# EAGLE board Resistor_Resistor (EAGLE 8.3.0), part 1 of 32
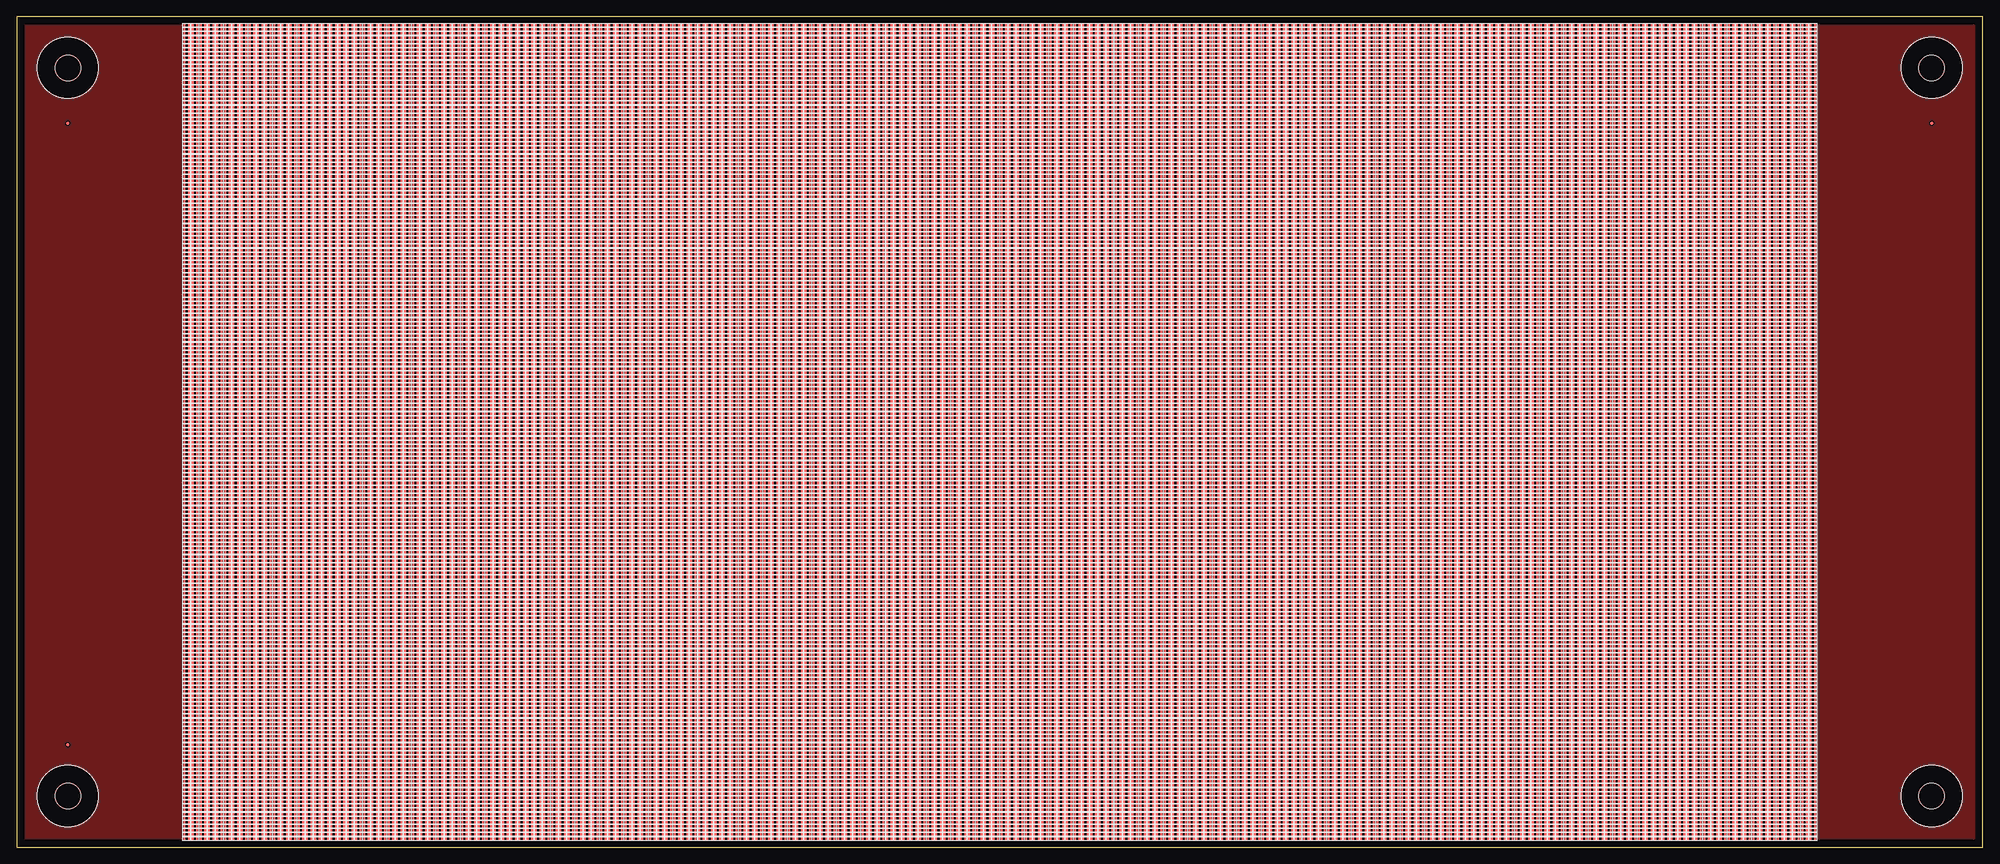
[diagram p9: board, top side]
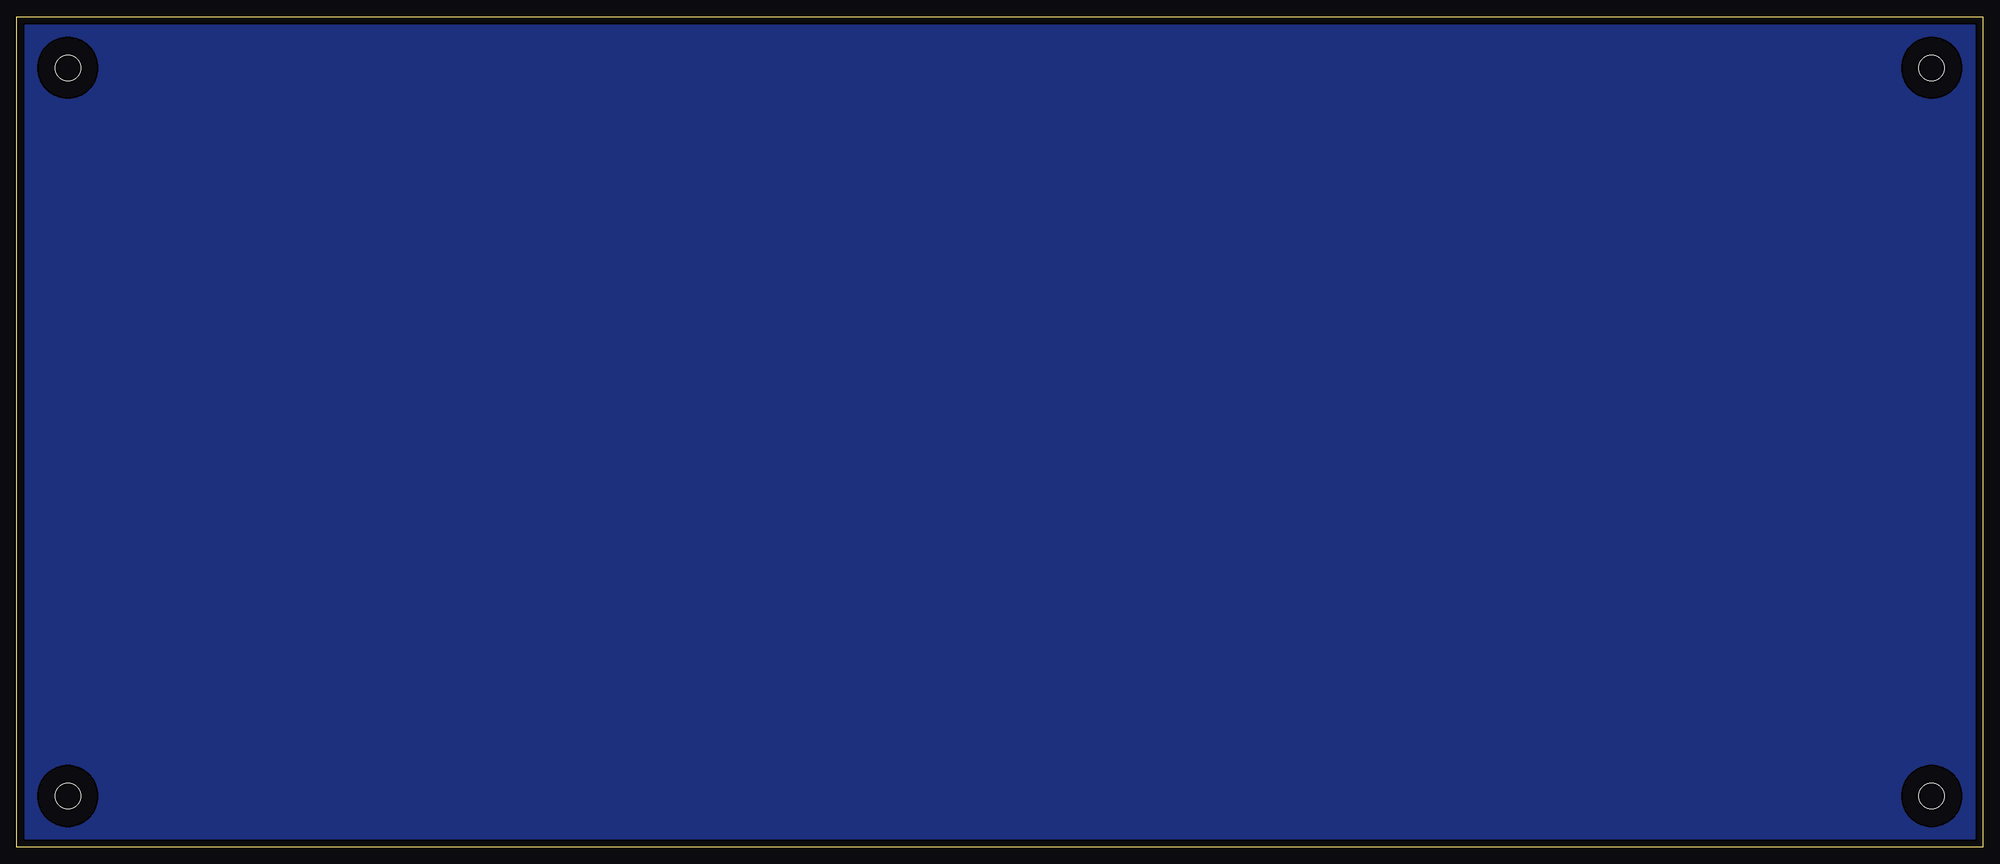
[diagram p10: board, bottom side, seen from below]

Size 293.32 x 123.85 mm. Coordinates in mm from the lower left corner, seen from the top.
Outline: 0,0 293.32,0 293.32,123.85 0,123.85 0,0
Copper layers (1*16): Top 0.035mm / dielectric 1.5mm / Bottom 0.035mm
Design rules "default": minimum track width 6mil, minimum drill 0.35mm, track to track 6mil, track to pad 6mil, pad to pad 6mil, via to via 6mil, smd to smd 6mil, copper to edge 40mil, drill to drill 6mil, minimum pad ring 10mil, minimum via ring 8mil, stop-mask expansion 4mil, vias tented up to drill 0mil, thermal gap 10mil

## Footprints (pad centres in the part's own frame; a part is rotated, then mirrored left to right if it is on the bottom)
FIDUCIAL_0.5MM = smd 0.5 x 0.5: FID 0,0
0201 = smd 0.25 x 0.35: 1 -0.325,0; 2 0.325,0
MOUNT_HOLE_150MIL = hole 3.81: 0,0

## Placement (x,y rotation side)
FID1  FIDUCIAL_0.5MM  [FIDUCIAL_0.5MM]  7.57,15.24 0 top
FID2  FIDUCIAL_0.5MM  [FIDUCIAL_0.5MM]  7.57,107.95 0 top
FID3  FIDUCIAL_0.5MM  [FIDUCIAL_0.5MM]  285.7,107.95 0 top
R1  10K  [0201]  25.35,1.27 0 top
R2  10K  [0201]  25.35,1.88 0 top
R3  10K  [0201]  25.35,2.49 0 top
R4  10K  [0201]  25.35,3.1 0 top
R5  10K  [0201]  25.35,3.71 0 top
R6  10K  [0201]  25.35,4.32 0 top
R7  10K  [0201]  25.35,4.93 0 top
R8  10K  [0201]  25.35,5.54 0 top
R9  10K  [0201]  25.35,6.15 0 top
R10  10K  [0201]  25.35,6.76 0 top
R11  10K  [0201]  25.35,7.37 0 top
R12  10K  [0201]  25.35,7.98 0 top
R13  10K  [0201]  25.35,8.59 0 top
R14  10K  [0201]  25.35,9.19 0 top
R15  10K  [0201]  25.35,9.8 0 top
R16  10K  [0201]  25.35,10.41 0 top
R17  10K  [0201]  25.35,11.02 0 top
R18  10K  [0201]  25.35,11.63 0 top
R19  10K  [0201]  25.35,12.24 0 top
R20  10K  [0201]  25.35,12.85 0 top
R21  10K  [0201]  25.35,13.46 0 top
R22  10K  [0201]  25.35,14.07 0 top
R23  10K  [0201]  25.35,14.68 0 top
R24  10K  [0201]  25.35,15.29 0 top
R25  10K  [0201]  25.35,15.9 0 top
R26  10K  [0201]  25.35,16.51 0 top
R27  10K  [0201]  25.35,17.12 0 top
R28  10K  [0201]  25.35,17.73 0 top
R29  10K  [0201]  25.35,18.34 0 top
R30  10K  [0201]  25.35,18.95 0 top
R31  10K  [0201]  25.35,19.56 0 top
R32  10K  [0201]  25.35,20.17 0 top
R33  10K  [0201]  25.35,20.78 0 top
R34  10K  [0201]  25.35,21.39 0 top
R35  10K  [0201]  25.35,22 0 top
R36  10K  [0201]  25.35,22.61 0 top
R37  10K  [0201]  25.35,23.22 0 top
R38  10K  [0201]  25.35,23.83 0 top
R39  10K  [0201]  25.35,24.43 0 top
R40  10K  [0201]  25.35,25.04 0 top
R41  10K  [0201]  25.35,25.65 0 top
R42  10K  [0201]  25.35,26.26 0 top
R43  10K  [0201]  25.35,26.87 0 top
R44  10K  [0201]  25.35,27.48 0 top
R45  10K  [0201]  25.35,28.09 0 top
R46  10K  [0201]  25.35,28.7 0 top
R47  10K  [0201]  25.35,29.31 0 top
R48  10K  [0201]  25.35,29.92 0 top
R49  10K  [0201]  25.35,30.53 0 top
R50  10K  [0201]  25.35,31.14 0 top
R51  10K  [0201]  25.35,31.75 0 top
R52  10K  [0201]  25.35,32.36 0 top
R53  10K  [0201]  25.35,32.97 0 top
R54  10K  [0201]  25.35,33.58 0 top
R55  10K  [0201]  25.35,34.19 0 top
R56  10K  [0201]  25.35,34.8 0 top
R57  10K  [0201]  25.35,35.41 0 top
R58  10K  [0201]  25.35,36.02 0 top
R59  10K  [0201]  25.35,36.63 0 top
R60  10K  [0201]  25.35,37.24 0 top
R61  10K  [0201]  25.35,37.85 0 top
R62  10K  [0201]  25.35,38.46 0 top
R63  10K  [0201]  25.35,39.07 0 top
R64  10K  [0201]  25.35,39.67 0 top
R65  10K  [0201]  25.35,40.28 0 top
R66  10K  [0201]  25.35,40.89 0 top
R67  10K  [0201]  25.35,41.5 0 top
R68  10K  [0201]  25.35,42.11 0 top
R69  10K  [0201]  25.35,42.72 0 top
R70  10K  [0201]  25.35,43.33 0 top
R71  10K  [0201]  25.35,43.94 0 top
R72  10K  [0201]  25.35,44.55 0 top
R73  10K  [0201]  25.35,45.16 0 top
R74  10K  [0201]  25.35,45.77 0 top
R75  10K  [0201]  25.35,46.38 0 top
R76  10K  [0201]  25.35,46.99 0 top
R77  10K  [0201]  25.35,47.6 0 top
R78  10K  [0201]  25.35,48.21 0 top
R79  10K  [0201]  25.35,48.82 0 top
R80  10K  [0201]  25.35,49.43 0 top
R81  10K  [0201]  25.35,50.04 0 top
R82  10K  [0201]  25.35,50.65 0 top
R83  10K  [0201]  25.35,51.26 0 top
R84  10K  [0201]  25.35,51.87 0 top
R85  10K  [0201]  25.35,52.48 0 top
R86  10K  [0201]  25.35,53.09 0 top
R87  10K  [0201]  25.35,53.7 0 top
R88  10K  [0201]  25.35,54.31 0 top
R89  10K  [0201]  25.35,54.91 0 top
R90  10K  [0201]  25.35,55.52 0 top
R91  10K  [0201]  25.35,56.13 0 top
R92  10K  [0201]  25.35,56.74 0 top
R93  10K  [0201]  25.35,57.35 0 top
R94  10K  [0201]  25.35,57.96 0 top
R95  10K  [0201]  25.35,58.57 0 top
R96  10K  [0201]  25.35,59.18 0 top
R97  10K  [0201]  25.35,59.79 0 top
R98  10K  [0201]  25.35,60.4 0 top
R99  10K  [0201]  25.35,61.01 0 top
R100  10K  [0201]  25.35,61.62 0 top
R101  10K  [0201]  25.35,62.23 0 top
R102  10K  [0201]  25.35,62.84 0 top
R103  10K  [0201]  25.35,63.45 0 top
R104  10K  [0201]  25.35,64.06 0 top
R105  10K  [0201]  25.35,64.67 0 top
R106  10K  [0201]  25.35,65.28 0 top
R107  10K  [0201]  25.35,65.89 0 top
R108  10K  [0201]  25.35,66.5 0 top
R109  10K  [0201]  25.35,67.11 0 top
R110  10K  [0201]  25.35,67.72 0 top
R111  10K  [0201]  25.35,68.33 0 top
R112  10K  [0201]  25.35,68.94 0 top
R113  10K  [0201]  25.35,69.55 0 top
R114  10K  [0201]  25.35,70.15 0 top
R115  10K  [0201]  25.35,70.76 0 top
R116  10K  [0201]  25.35,71.37 0 top
R117  10K  [0201]  25.35,71.98 0 top
R118  10K  [0201]  25.35,72.59 0 top
R119  10K  [0201]  25.35,73.2 0 top
R120  10K  [0201]  25.35,73.81 0 top
R121  10K  [0201]  25.35,74.42 0 top
R122  10K  [0201]  25.35,75.03 0 top
R123  10K  [0201]  25.35,75.64 0 top
R124  10K  [0201]  25.35,76.25 0 top
R125  10K  [0201]  25.35,76.86 0 top
R126  10K  [0201]  25.35,77.47 0 top
R127  10K  [0201]  25.35,78.08 0 top
R128  10K  [0201]  25.35,78.69 0 top
R129  10K  [0201]  25.35,79.3 0 top
R130  10K  [0201]  25.35,79.91 0 top
R131  10K  [0201]  25.35,80.52 0 top
R132  10K  [0201]  25.35,81.13 0 top
R133  10K  [0201]  25.35,81.74 0 top
R134  10K  [0201]  25.35,82.35 0 top
R135  10K  [0201]  25.35,82.96 0 top
R136  10K  [0201]  25.35,83.57 0 top
R137  10K  [0201]  25.35,84.18 0 top
R138  10K  [0201]  25.35,84.79 0 top
R139  10K  [0201]  25.35,85.39 0 top
R140  10K  [0201]  25.35,86 0 top
R141  10K  [0201]  25.35,86.61 0 top
R142  10K  [0201]  25.35,87.22 0 top
R143  10K  [0201]  25.35,87.83 0 top
R144  10K  [0201]  25.35,88.44 0 top
R145  10K  [0201]  25.35,89.05 0 top
R146  10K  [0201]  25.35,89.66 0 top
R147  10K  [0201]  25.35,90.27 0 top
R148  10K  [0201]  25.35,90.88 0 top
R149  10K  [0201]  25.35,91.49 0 top
R150  10K  [0201]  25.35,92.1 0 top
R151  10K  [0201]  25.35,92.71 0 top
R152  10K  [0201]  25.35,93.32 0 top
R153  10K  [0201]  25.35,93.93 0 top
R154  10K  [0201]  25.35,94.54 0 top
R155  10K  [0201]  25.35,95.15 0 top
R156  10K  [0201]  25.35,95.76 0 top
R157  10K  [0201]  25.35,96.37 0 top
R158  10K  [0201]  25.35,96.98 0 top
R159  10K  [0201]  25.35,97.59 0 top
R160  10K  [0201]  25.35,98.2 0 top
R161  10K  [0201]  25.35,98.81 0 top
R162  10K  [0201]  25.35,99.42 0 top
R163  10K  [0201]  25.35,100.03 0 top
R164  10K  [0201]  25.35,100.63 0 top
R165  10K  [0201]  25.35,101.24 0 top
R166  10K  [0201]  25.35,101.85 0 top
R167  10K  [0201]  25.35,102.46 0 top
R168  10K  [0201]  25.35,103.07 0 top
R169  10K  [0201]  25.35,103.68 0 top
R170  10K  [0201]  25.35,104.29 0 top
R171  10K  [0201]  25.35,104.9 0 top
R172  10K  [0201]  25.35,105.51 0 top
R173  10K  [0201]  25.35,106.12 0 top
R174  10K  [0201]  25.35,106.73 0 top
R175  10K  [0201]  25.35,107.34 0 top
R176  10K  [0201]  25.35,107.95 0 top
R177  10K  [0201]  25.35,108.56 0 top
R178  10K  [0201]  25.35,109.17 0 top
R179  10K  [0201]  25.35,109.78 0 top
R180  10K  [0201]  25.35,110.39 0 top
R181  10K  [0201]  25.35,111 0 top
R182  10K  [0201]  25.35,111.61 0 top
R183  10K  [0201]  25.35,112.22 0 top
R184  10K  [0201]  25.35,112.83 0 top
R185  10K  [0201]  25.35,113.44 0 top
R186  10K  [0201]  25.35,114.05 0 top
R187  10K  [0201]  25.35,114.66 0 top
R188  10K  [0201]  25.35,115.27 0 top
R189  10K  [0201]  25.35,115.87 0 top
R190  10K  [0201]  25.35,116.48 0 top
R191  10K  [0201]  25.35,117.09 0 top
R192  10K  [0201]  25.35,117.7 0 top
R193  10K  [0201]  25.35,118.31 0 top
R194  10K  [0201]  25.35,118.92 0 top
R195  10K  [0201]  25.35,119.53 0 top
R196  10K  [0201]  25.35,120.14 0 top
R197  10K  [0201]  25.35,120.75 0 top
R198  10K  [0201]  25.35,121.36 0 top
R199  10K  [0201]  25.35,121.97 0 top
R200  10K  [0201]  25.35,122.58 0 top
R201  10K  [0201]  26.57,1.27 0 top
R202  10K  [0201]  26.57,1.88 0 top
R203  10K  [0201]  26.57,2.49 0 top
R204  10K  [0201]  26.57,3.1 0 top
R205  10K  [0201]  26.57,3.71 0 top
R206  10K  [0201]  26.57,4.32 0 top
R207  10K  [0201]  26.57,4.93 0 top
R208  10K  [0201]  26.57,5.54 0 top
R209  10K  [0201]  26.57,6.15 0 top
R210  10K  [0201]  26.57,6.76 0 top
R211  10K  [0201]  26.57,7.37 0 top
R212  10K  [0201]  26.57,7.98 0 top
R213  10K  [0201]  26.57,8.59 0 top
R214  10K  [0201]  26.57,9.19 0 top
R215  10K  [0201]  26.57,9.8 0 top
R216  10K  [0201]  26.57,10.41 0 top
R217  10K  [0201]  26.57,11.02 0 top
R218  10K  [0201]  26.57,11.63 0 top
R219  10K  [0201]  26.57,12.24 0 top
R220  10K  [0201]  26.57,12.85 0 top
R221  10K  [0201]  26.57,13.46 0 top
R222  10K  [0201]  26.57,14.07 0 top
R223  10K  [0201]  26.57,14.68 0 top
R224  10K  [0201]  26.57,15.29 0 top
R225  10K  [0201]  26.57,15.9 0 top
R226  10K  [0201]  26.57,16.51 0 top
R227  10K  [0201]  26.57,17.12 0 top
R228  10K  [0201]  26.57,17.73 0 top
R229  10K  [0201]  26.57,18.34 0 top
R230  10K  [0201]  26.57,18.95 0 top
R231  10K  [0201]  26.57,19.56 0 top
R232  10K  [0201]  26.57,20.17 0 top
R233  10K  [0201]  26.57,20.78 0 top
R234  10K  [0201]  26.57,21.39 0 top
R235  10K  [0201]  26.57,22 0 top
R236  10K  [0201]  26.57,22.61 0 top
R237  10K  [0201]  26.57,23.22 0 top
R238  10K  [0201]  26.57,23.83 0 top
R239  10K  [0201]  26.57,24.43 0 top
R240  10K  [0201]  26.57,25.04 0 top
R241  10K  [0201]  26.57,25.65 0 top
R242  10K  [0201]  26.57,26.26 0 top
R243  10K  [0201]  26.57,26.87 0 top
R244  10K  [0201]  26.57,27.48 0 top
R245  10K  [0201]  26.57,28.09 0 top
R246  10K  [0201]  26.57,28.7 0 top
R247  10K  [0201]  26.57,29.31 0 top
R248  10K  [0201]  26.57,29.92 0 top
R249  10K  [0201]  26.57,30.53 0 top
R250  10K  [0201]  26.57,31.14 0 top
R251  10K  [0201]  26.57,31.75 0 top
R252  10K  [0201]  26.57,32.36 0 top
R253  10K  [0201]  26.57,32.97 0 top
R254  10K  [0201]  26.57,33.58 0 top
R255  10K  [0201]  26.57,34.19 0 top
R256  10K  [0201]  26.57,34.8 0 top
R257  10K  [0201]  26.57,35.41 0 top
R258  10K  [0201]  26.57,36.02 0 top
R259  10K  [0201]  26.57,36.63 0 top
R260  10K  [0201]  26.57,37.24 0 top
R261  10K  [0201]  26.57,37.85 0 top
R262  10K  [0201]  26.57,38.46 0 top
R263  10K  [0201]  26.57,39.07 0 top
R264  10K  [0201]  26.57,39.67 0 top
R265  10K  [0201]  26.57,40.28 0 top
R266  10K  [0201]  26.57,40.89 0 top
R267  10K  [0201]  26.57,41.5 0 top
R268  10K  [0201]  26.57,42.11 0 top
R269  10K  [0201]  26.57,42.72 0 top
R270  10K  [0201]  26.57,43.33 0 top
R271  10K  [0201]  26.57,43.94 0 top
R272  10K  [0201]  26.57,44.55 0 top
R273  10K  [0201]  26.57,45.16 0 top
R274  10K  [0201]  26.57,45.77 0 top
R275  10K  [0201]  26.57,46.38 0 top
R276  10K  [0201]  26.57,46.99 0 top
R277  10K  [0201]  26.57,47.6 0 top
R278  10K  [0201]  26.57,48.21 0 top
R279  10K  [0201]  26.57,48.82 0 top
R280  10K  [0201]  26.57,49.43 0 top
R281  10K  [0201]  26.57,50.04 0 top
R282  10K  [0201]  26.57,50.65 0 top
R283  10K  [0201]  26.57,51.26 0 top
R284  10K  [0201]  26.57,51.87 0 top
R285  10K  [0201]  26.57,52.48 0 top
R286  10K  [0201]  26.57,53.09 0 top
R287  10K  [0201]  26.57,53.7 0 top
R288  10K  [0201]  26.57,54.31 0 top
R289  10K  [0201]  26.57,54.91 0 top
R290  10K  [0201]  26.57,55.52 0 top
R291  10K  [0201]  26.57,56.13 0 top
R292  10K  [0201]  26.57,56.74 0 top
R293  10K  [0201]  26.57,57.35 0 top
R294  10K  [0201]  26.57,57.96 0 top
R295  10K  [0201]  26.57,58.57 0 top
R296  10K  [0201]  26.57,59.18 0 top
R297  10K  [0201]  26.57,59.79 0 top
R298  10K  [0201]  26.57,60.4 0 top
R299  10K  [0201]  26.57,61.01 0 top
R300  10K  [0201]  26.57,61.62 0 top
R301  10K  [0201]  26.57,62.23 0 top
R302  10K  [0201]  26.57,62.84 0 top
R303  10K  [0201]  26.57,63.45 0 top
R304  10K  [0201]  26.57,64.06 0 top
R305  10K  [0201]  26.57,64.67 0 top
R306  10K  [0201]  26.57,65.28 0 top
R307  10K  [0201]  26.57,65.89 0 top
R308  10K  [0201]  26.57,66.5 0 top
R309  10K  [0201]  26.57,67.11 0 top
R310  10K  [0201]  26.57,67.72 0 top
R311  10K  [0201]  26.57,68.33 0 top
R312  10K  [0201]  26.57,68.94 0 top
R313  10K  [0201]  26.57,69.55 0 top
R314  10K  [0201]  26.57,70.15 0 top
R315  10K  [0201]  26.57,70.76 0 top
R316  10K  [0201]  26.57,71.37 0 top
R317  10K  [0201]  26.57,71.98 0 top
R318  10K  [0201]  26.57,72.59 0 top
R319  10K  [0201]  26.57,73.2 0 top
R320  10K  [0201]  26.57,73.81 0 top
R321  10K  [0201]  26.57,74.42 0 top
R322  10K  [0201]  26.57,75.03 0 top
R323  10K  [0201]  26.57,75.64 0 top
R324  10K  [0201]  26.57,76.25 0 top
R325  10K  [0201]  26.57,76.86 0 top
R326  10K  [0201]  26.57,77.47 0 top
R327  10K  [0201]  26.57,78.08 0 top
R328  10K  [0201]  26.57,78.69 0 top
R329  10K  [0201]  26.57,79.3 0 top
R330  10K  [0201]  26.57,79.91 0 top
R331  10K  [0201]  26.57,80.52 0 top
R332  10K  [0201]  26.57,81.13 0 top
R333  10K  [0201]  26.57,81.74 0 top
R334  10K  [0201]  26.57,82.35 0 top
R335  10K  [0201]  26.57,82.96 0 top
R336  10K  [0201]  26.57,83.57 0 top
R337  10K  [0201]  26.57,84.18 0 top
R338  10K  [0201]  26.57,84.79 0 top
R339  10K  [0201]  26.57,85.39 0 top
R340  10K  [0201]  26.57,86 0 top
R341  10K  [0201]  26.57,86.61 0 top
R342  10K  [0201]  26.57,87.22 0 top
R343  10K  [0201]  26.57,87.83 0 top
R344  10K  [0201]  26.57,88.44 0 top
R345  10K  [0201]  26.57,89.05 0 top
R346  10K  [0201]  26.57,89.66 0 top
R347  10K  [0201]  26.57,90.27 0 top
R348  10K  [0201]  26.57,90.88 0 top
R349  10K  [0201]  26.57,91.49 0 top
R350  10K  [0201]  26.57,92.1 0 top
R351  10K  [0201]  26.57,92.71 0 top
R352  10K  [0201]  26.57,93.32 0 top
R353  10K  [0201]  26.57,93.93 0 top
R354  10K  [0201]  26.57,94.54 0 top
R355  10K  [0201]  26.57,95.15 0 top
R356  10K  [0201]  26.57,95.76 0 top
R357  10K  [0201]  26.57,96.37 0 top
R358  10K  [0201]  26.57,96.98 0 top
R359  10K  [0201]  26.57,97.59 0 top
R360  10K  [0201]  26.57,98.2 0 top
R361  10K  [0201]  26.57,98.81 0 top
R362  10K  [0201]  26.57,99.42 0 top
R363  10K  [0201]  26.57,100.03 0 top
R364  10K  [0201]  26.57,100.63 0 top
R365  10K  [0201]  26.57,101.24 0 top
R366  10K  [0201]  26.57,101.85 0 top
R367  10K  [0201]  26.57,102.46 0 top
R368  10K  [0201]  26.57,103.07 0 top
R369  10K  [0201]  26.57,103.68 0 top
R370  10K  [0201]  26.57,104.29 0 top
R371  10K  [0201]  26.57,104.9 0 top
R372  10K  [0201]  26.57,105.51 0 top
R373  10K  [0201]  26.57,106.12 0 top
R374  10K  [0201]  26.57,106.73 0 top
R375  10K  [0201]  26.57,107.34 0 top
R376  10K  [0201]  26.57,107.95 0 top
R377  10K  [0201]  26.57,108.56 0 top
R378  10K  [0201]  26.57,109.17 0 top
R379  10K  [0201]  26.57,109.78 0 top
R380  10K  [0201]  26.57,110.39 0 top
R381  10K  [0201]  26.57,111 0 top
R382  10K  [0201]  26.57,111.61 0 top
R383  10K  [0201]  26.57,112.22 0 top
R384  10K  [0201]  26.57,112.83 0 top
R385  10K  [0201]  26.57,113.44 0 top
R386  10K  [0201]  26.57,114.05 0 top
R387  10K  [0201]  26.57,114.66 0 top
R388  10K  [0201]  26.57,115.27 0 top
R389  10K  [0201]  26.57,115.87 0 top
R390  10K  [0201]  26.57,116.48 0 top
R391  10K  [0201]  26.57,117.09 0 top
R392  10K  [0201]  26.57,117.7 0 top
R393  10K  [0201]  26.57,118.31 0 top
R394  10K  [0201]  26.57,118.92 0 top
R395  10K  [0201]  26.57,119.53 0 top
R396  10K  [0201]  26.57,120.14 0 top
R397  10K  [0201]  26.57,120.75 0 top
R398  10K  [0201]  26.57,121.36 0 top
R399  10K  [0201]  26.57,121.97 0 top
R400  10K  [0201]  26.57,122.58 0 top
R401  10K  [0201]  27.79,1.27 0 top
R402  10K  [0201]  27.79,1.88 0 top
R403  10K  [0201]  27.79,2.49 0 top
R404  10K  [0201]  27.79,3.1 0 top
R405  10K  [0201]  27.79,3.71 0 top
R406  10K  [0201]  27.79,4.32 0 top
R407  10K  [0201]  27.79,4.93 0 top
R408  10K  [0201]  27.79,5.54 0 top
R409  10K  [0201]  27.79,6.15 0 top
R410  10K  [0201]  27.79,6.76 0 top
R411  10K  [0201]  27.79,7.37 0 top
R412  10K  [0201]  27.79,7.98 0 top
R413  10K  [0201]  27.79,8.59 0 top
R414  10K  [0201]  27.79,9.19 0 top
R415  10K  [0201]  27.79,9.8 0 top
R416  10K  [0201]  27.79,10.41 0 top
R417  10K  [0201]  27.79,11.02 0 top
R418  10K  [0201]  27.79,11.63 0 top
R419  10K  [0201]  27.79,12.24 0 top
R420  10K  [0201]  27.79,12.85 0 top
R421  10K  [0201]  27.79,13.46 0 top
R422  10K  [0201]  27.79,14.07 0 top
R423  10K  [0201]  27.79,14.68 0 top
R424  10K  [0201]  27.79,15.29 0 top
R425  10K  [0201]  27.79,15.9 0 top
R426  10K  [0201]  27.79,16.51 0 top
R427  10K  [0201]  27.79,17.12 0 top
R428  10K  [0201]  27.79,17.73 0 top
R429  10K  [0201]  27.79,18.34 0 top
R430  10K  [0201]  27.79,18.95 0 top
R431  10K  [0201]  27.79,19.56 0 top
R432  10K  [0201]  27.79,20.17 0 top
R433  10K  [0201]  27.79,20.78 0 top
R434  10K  [0201]  27.79,21.39 0 top
R435  10K  [0201]  27.79,22 0 top
R436  10K  [0201]  27.79,22.61 0 top
R437  10K  [0201]  27.79,23.22 0 top
R438  10K  [0201]  27.79,23.83 0 top
R439  10K  [0201]  27.79,24.43 0 top
R440  10K  [0201]  27.79,25.04 0 top
R441  10K  [0201]  27.79,25.65 0 top
R442  10K  [0201]  27.79,26.26 0 top
R443  10K  [0201]  27.79,26.87 0 top
R444  10K  [0201]  27.79,27.48 0 top
R445  10K  [0201]  27.79,28.09 0 top
R446  10K  [0201]  27.79,28.7 0 top
R447  10K  [0201]  27.79,29.31 0 top
R448  10K  [0201]  27.79,29.92 0 top
R449  10K  [0201]  27.79,30.53 0 top
R450  10K  [0201]  27.79,31.14 0 top
R451  10K  [0201]  27.79,31.75 0 top
R452  10K  [0201]  27.79,32.36 0 top
R453  10K  [0201]  27.79,32.97 0 top
R454  10K  [0201]  27.79,33.58 0 top
R455  10K  [0201]  27.79,34.19 0 top
R456  10K  [0201]  27.79,34.8 0 top
R457  10K  [0201]  27.79,35.41 0 top
R458  10K  [0201]  27.79,36.02 0 top
R459  10K  [0201]  27.79,36.63 0 top
R460  10K  [0201]  27.79,37.24 0 top
R461  10K  [0201]  27.79,37.85 0 top
R462  10K  [0201]  27.79,38.46 0 top
R463  10K  [0201]  27.79,39.07 0 top
R464  10K  [0201]  27.79,39.67 0 top
R465  10K  [0201]  27.79,40.28 0 top
R466  10K  [0201]  27.79,40.89 0 top
R467  10K  [0201]  27.79,41.5 0 top
R468  10K  [0201]  27.79,42.11 0 top
R469  10K  [0201]  27.79,42.72 0 top
R470  10K  [0201]  27.79,43.33 0 top
R471  10K  [0201]  27.79,43.94 0 top
R472  10K  [0201]  27.79,44.55 0 top
R473  10K  [0201]  27.79,45.16 0 top
R474  10K  [0201]  27.79,45.77 0 top
R475  10K  [0201]  27.79,46.38 0 top
R476  10K  [0201]  27.79,46.99 0 top
R477  10K  [0201]  27.79,47.6 0 top
R478  10K  [0201]  27.79,48.21 0 top
R479  10K  [0201]  27.79,48.82 0 top
R480  10K  [0201]  27.79,49.43 0 top
R481  10K  [0201]  27.79,50.04 0 top
R482  10K  [0201]  27.79,50.65 0 top
R483  10K  [0201]  27.79,51.26 0 top
R484  10K  [0201]  27.79,51.87 0 top
R485  10K  [0201]  27.79,52.48 0 top
R486  10K  [0201]  27.79,53.09 0 top
R487  10K  [0201]  27.79,53.7 0 top
R488  10K  [0201]  27.79,54.31 0 top
R489  10K  [0201]  27.79,54.91 0 top
R490  10K  [0201]  27.79,55.52 0 top
R491  10K  [0201]  27.79,56.13 0 top
R492  10K  [0201]  27.79,56.74 0 top
R493  10K  [0201]  27.79,57.35 0 top
R494  10K  [0201]  27.79,57.96 0 top
R495  10K  [0201]  27.79,58.57 0 top
R496  10K  [0201]  27.79,59.18 0 top
R497  10K  [0201]  27.79,59.79 0 top
R498  10K  [0201]  27.79,60.4 0 top
R499  10K  [0201]  27.79,61.01 0 top
R500  10K  [0201]  27.79,61.62 0 top
R501  10K  [0201]  27.79,62.23 0 top
R502  10K  [0201]  27.79,62.84 0 top
R503  10K  [0201]  27.79,63.45 0 top
R504  10K  [0201]  27.79,64.06 0 top
R505  10K  [0201]  27.79,64.67 0 top
R506  10K  [0201]  27.79,65.28 0 top
R507  10K  [0201]  27.79,65.89 0 top
R508  10K  [0201]  27.79,66.5 0 top
R509  10K  [0201]  27.79,67.11 0 top
R510  10K  [0201]  27.79,67.72 0 top
R511  10K  [0201]  27.79,68.33 0 top
R512  10K  [0201]  27.79,68.94 0 top
R513  10K  [0201]  27.79,69.55 0 top
R514  10K  [0201]  27.79,70.15 0 top
R515  10K  [0201]  27.79,70.76 0 top
R516  10K  [0201]  27.79,71.37 0 top
R517  10K  [0201]  27.79,71.98 0 top
R518  10K  [0201]  27.79,72.59 0 top
R519  10K  [0201]  27.79,73.2 0 top
R520  10K  [0201]  27.79,73.81 0 top
R521  10K  [0201]  27.79,74.42 0 top
R522  10K  [0201]  27.79,75.03 0 top
R523  10K  [0201]  27.79,75.64 0 top
R524  10K  [0201]  27.79,76.25 0 top
R525  10K  [0201]  27.79,76.86 0 top
R526  10K  [0201]  27.79,77.47 0 top
R527  10K  [0201]  27.79,78.08 0 top
R528  10K  [0201]  27.79,78.69 0 top
R529  10K  [0201]  27.79,79.3 0 top
R530  10K  [0201]  27.79,79.91 0 top
R531  10K  [0201]  27.79,80.52 0 top
R532  10K  [0201]  27.79,81.13 0 top
R533  10K  [0201]  27.79,81.74 0 top
R534  10K  [0201]  27.79,82.35 0 top
R535  10K  [0201]  27.79,82.96 0 top
R536  10K  [0201]  27.79,83.57 0 top
R537  10K  [0201]  27.79,84.18 0 top
R538  10K  [0201]  27.79,84.79 0 top
R539  10K  [0201]  27.79,85.39 0 top
R540  10K  [0201]  27.79,86 0 top
R541  10K  [0201]  27.79,86.61 0 top
R542  10K  [0201]  27.79,87.22 0 top
R543  10K  [0201]  27.79,87.83 0 top
R544  10K  [0201]  27.79,88.44 0 top
R545  10K  [0201]  27.79,89.05 0 top
R546  10K  [0201]  27.79,89.66 0 top
R547  10K  [0201]  27.79,90.27 0 top
R548  10K  [0201]  27.79,90.88 0 top
R549  10K  [0201]  27.79,91.49 0 top